# EasyEDA Pro project kuafu01_030内部老化方案_4.eprj, board PCB4 (continued)
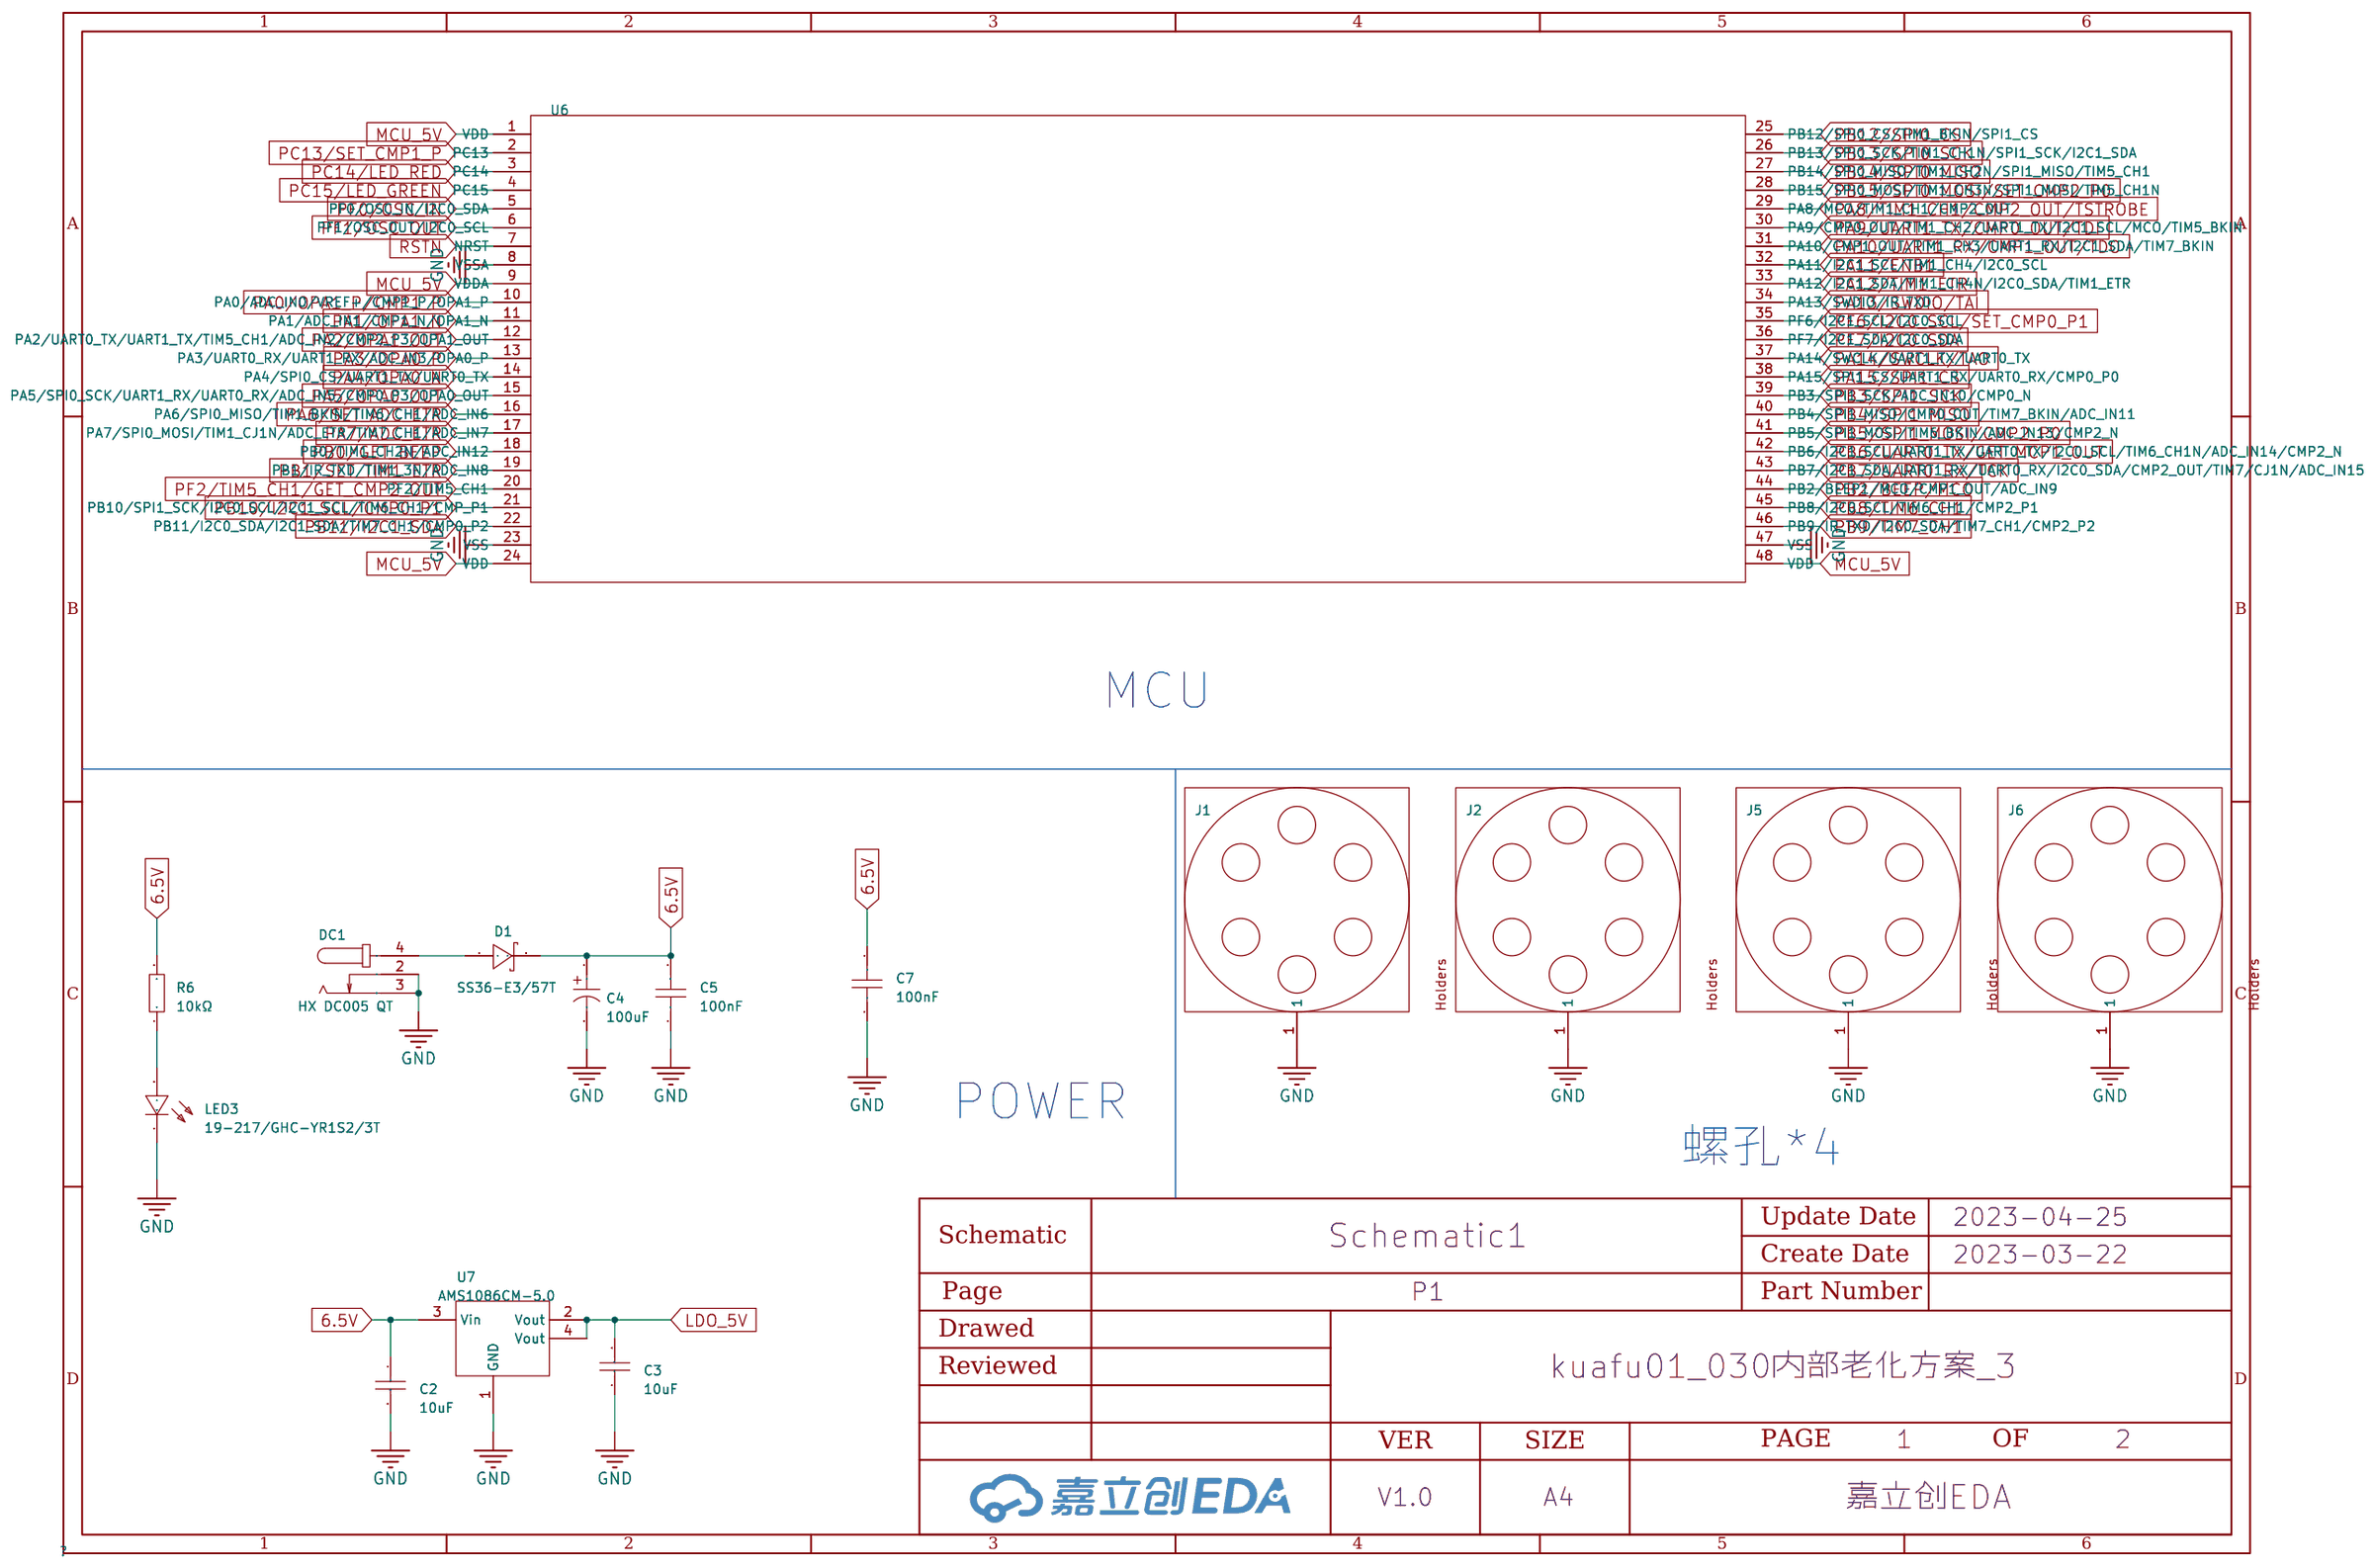
[diagram p0: P1]
## Routing (per net, layer and track width the routed paths; a pad name or vN(x,y) marks a point on that pad's centre or on a via; arc(x,y) is an arc through that point) (continued)
  Bottom Layer w0.5: v2(101.11,39.43) 103.02,41.34 v2(103.02,41.71) ; v2(101.11,114.62) 103.02,116.53 v2(103.02,116.9) ; v2(52.47,116.9) 52.47,116.53 v2(50.56,114.62) ; v2(103.02,192.08) 103.02,191.71 v2(101.11,189.8) ; v2(103.02,158.45) 103.02,164.68 v2(103.04,164.7) ; v2(204.13,127.11) 204.11,127.09 v2(204.11,120.86) ; v2(202.2,39.43) 204.11,41.34 v2(204.11,41.71) ; v2(103.02,154.49) 103.02,154.12 v2(101.11,152.21) ; v2(254.66,158.45) 254.66,164.68 v2(254.68,164.7) ; v2(153.57,83.27) 153.57,89.5 v2(153.59,89.52) ; v2(52.47,229.67) 52.47,229.3 v2(50.56,227.39) ; v2(52.47,79.31) 52.47,78.94 v2(50.56,77.03) ; v2(103.02,196.04) 103.02,202.27 v2(103.04,202.29) ; v2(52.47,120.86) 52.47,127.09 v2(52.49,127.11) ; v2(252.75,114.62) 254.66,116.53 v2(254.66,116.9) ; v2(153.59,51.92) 153.57,51.9 v2(153.57,45.67) ; v2(103.04,127.11) 103.02,127.09 v2(103.02,120.86) ; v2(52.47,196.04) 52.47,202.27 v2(52.49,202.29) ; v2(204.13,239.88) 204.11,239.86 v2(204.11,233.63) ; v2(153.59,164.7) 153.57,164.68 v2(153.57,158.45) ; v2(151.66,39.43) 153.57,41.34 v2(153.57,41.71) ; v2(204.11,79.31) 204.11,78.94 v2(202.2,77.03) ; v2(52.47,45.67) 52.47,51.9 v2(52.49,51.92) ; v2(50.56,189.8) 52.47,191.71 v2(52.47,192.08) ; v2(101.11,77.03) 103.02,78.94 v2(103.02,79.31) ; v2(103.02,83.27) 103.02,89.5 v2(103.04,89.52) ; v2(50.56,39.43) 52.47,41.34 v2(52.47,41.71) ; v2(254.66,8.08) 254.66,14.31 v2(254.68,14.33) ; v2(254.68,202.29) 254.66,202.27 v2(254.66,196.04) ; v2(254.66,41.71) 254.66,41.34 v2(252.75,39.43) ; v2(153.57,233.63) 153.57,239.86 v2(153.59,239.88) ; v2(204.13,51.92) 204.11,51.9 v2(204.11,45.67) ; v2(50.56,152.21) 52.47,154.12 v2(52.47,154.49) ; v2(204.11,154.49) 204.11,154.12 v2(202.2,152.21) ; v2(204.11,158.45) 204.11,164.68 v2(204.13,164.7) ; v2(204.11,83.27) 204.11,89.5 v2(204.13,89.52) ; v2(254.68,51.92) 254.66,51.9 v2(254.66,45.67) ; v2(151.66,227.39) 153.57,229.3 v2(153.57,229.67) ; v2(103.02,233.63) 103.02,239.86 v2(103.04,239.88) ; v2(50.56,1.84) 52.47,3.75 v2(52.47,4.12) ; v2(52.47,8.08) 52.47,14.31 v2(52.49,14.33) ; v2(52.49,89.52) 52.47,89.5 v2(52.47,83.27) ; v2(153.57,116.9) 153.57,116.53 v2(151.66,114.62) ; v2(103.02,45.67) 103.02,51.9 v2(103.04,51.92) ; v2(52.47,233.63) 52.47,239.86 v2(52.49,239.88) ; v2(103.02,229.67) 103.02,229.3 v2(101.11,227.39) ; v2(202.2,189.8) 204.11,191.71 v2(204.11,192.08) ; v2(151.66,189.8) 153.57,191.71 v2(153.57,192.08) ; v2(254.66,233.63) 254.66,239.86 v2(254.68,239.88) ; v2(252.75,227.39) 254.66,229.3 v2(254.66,229.67) ; v2(254.68,89.52) 254.66,89.5 v2(254.66,83.27) ; v2(252.75,189.8) 254.66,191.71 v2(254.66,192.08) ; v2(254.66,154.49) 254.66,154.12 v2(252.75,152.21) ; v2(153.57,120.86) 153.57,127.09 v2(153.59,127.11) ; v2(204.11,196.04) 204.11,202.27 v2(204.13,202.29) ; v2(153.57,196.04) 153.57,202.27 v2(153.59,202.29) ; v2(153.57,79.31) 153.57,78.94 v2(151.66,77.03) ; v2(254.68,127.11) 254.66,127.09 v2(254.66,120.86) ; v2(153.57,154.49) 153.57,154.12 v2(151.66,152.21) ; v2(202.2,227.39) 204.11,229.3 v2(204.11,229.67) ; v2(252.75,1.84) 254.66,3.75 v2(254.66,4.12) ; v2(254.66,79.31) 254.66,78.94 v2(252.75,77.03) ; v2(202.2,114.62) 204.11,116.53 v2(204.11,116.9) ; v2(52.49,164.7) 52.47,164.68 v2(52.47,158.45)
PF0/OSC_IN: length 168.7
  Top Layer w0.28: X1#20.1 173.56,88.24 U6#21.5 ; X1#26.1 173.56,238.61 U6#25.5 ; 26.63,13.06 21.92,13.06 X1#24.1 ; U6#32.5 173.56,201.02 X1#32.1 ; X1#31.1 123.01,201.02 127.73,201.02 ; X1#9.1 173.56,163.42 U6#10.5 ; X1#7.1 224.1,125.83 228.82,125.83 ; 228.82,50.65 224.1,50.65 X1#18.1 ; 228.82,238.61 224.1,238.61 X1#27.1 ; U6#29.5 72.46,201.02 X1#30.1 ; U6#5.5 72.46,125.83 X1#10.1 ; 26.63,238.61 21.92,238.61 X1#23.1 ; X1#12.1 123.01,50.65 127.73,50.65 ; 228.82,13.06 224.1,13.06 X1#25.1 ; X1.1 72.46,238.61 U6.5 ; 127.73,238.61 123.01,238.61 X1#16.1 ; U6#18.5 173.56,50.65 X1#14.1 ; X1#4.1 173.56,125.83 U6#7.5 ; X1#28.1 224.1,201.02 228.82,201.02 ; 127.73,163.42 123.01,163.42 X1#8.1 ; 127.73,125.83 123.01,125.83 X1#2.1 ; X1#17.1 21.92,88.24 26.63,88.24 ; 26.63,125.83 21.92,125.83 X1#3.1 ; X1#5.1 224.1,163.42 228.82,163.42 ; 26.63,163.42 21.92,163.42 X1#6.1 ; X1#13.1 21.92,50.65 26.63,50.65 ; 228.82,88.24 224.1,88.24 X1#15.1 ; X1#19.1 123.01,88.24 127.73,88.24 ; U6#16.5 72.46,50.65 X1#21.1 ; X1#29.1 21.92,201.02 26.63,201.02 ; X1#22.1 72.46,88.24 U6#22.5 ; U6#11.5 72.46,163.42 X1#11.1
PF1/OSC_OUT: length 317.6
  Top Layer w0.28: 120.34,237.13 122.1,235.37 123.41,235.37 124.7,236.66 124.7,237.83 124.98,238.11 127.73,238.11 ; 127.73,87.74 124.98,87.74 124.7,87.46 124.7,86.29 123.41,85.01 122.1,85.01 120.34,86.76 ; 127.73,125.33 124.98,125.33 124.7,125.05 124.7,123.88 123.41,122.6 122.1,122.6 120.34,124.36 ; 228.82,125.33 226.07,125.33 225.79,125.05 225.79,123.88 224.51,122.6 223.19,122.6 221.44,124.36 ; 228.82,12.56 226.07,12.56 225.79,12.28 225.79,11.11 224.51,9.82 223.19,9.82 221.44,11.58 ; 19.25,11.58 21.01,9.82 22.32,9.82 23.61,11.11 23.61,12.28 23.89,12.56 26.63,12.56 ; 170.89,86.76 172.65,85.01 173.96,85.01 175.24,86.29 175.24,87.46 175.52,87.74 U6#21.6 ; U6#5.6 74.43,125.33 74.15,125.05 74.15,123.88 72.87,122.6 71.56,122.6 69.8,124.36 ; U6#10.6 175.52,162.92 175.24,162.64 175.24,161.47 173.96,160.19 172.65,160.19 170.89,161.95 ; 69.8,199.54 71.56,197.78 72.87,197.78 74.15,199.07 74.15,200.24 74.43,200.52 U6#29.6 ; 170.89,237.13 172.65,235.37 173.96,235.37 175.24,236.66 175.24,237.83 175.52,238.11 U6#25.6 ; 221.44,199.54 223.19,197.78 224.51,197.78 225.79,199.07 225.79,200.24 226.07,200.52 228.82,200.52 ; U6#16.6 74.43,50.15 74.15,49.87 74.15,48.7 72.87,47.41 71.56,47.41 69.8,49.17 ; 170.89,124.36 172.65,122.6 173.96,122.6 175.24,123.88 175.24,125.05 175.52,125.33 U6#7.6 ; 120.34,49.17 122.1,47.41 123.41,47.41 124.7,48.7 124.7,49.87 124.98,50.15 127.73,50.15 ; 127.73,162.92 124.98,162.92 124.7,162.64 124.7,161.47 123.41,160.19 122.1,160.19 120.34,161.95 ; 127.73,200.52 124.98,200.52 124.7,200.24 124.7,199.07 123.41,197.78 122.1,197.78 120.34,199.54 ; 26.63,162.92 23.89,162.92 23.61,162.64 23.61,161.47 22.32,160.19 21.01,160.19 19.25,161.95 ; 221.44,49.17 223.19,47.41 224.51,47.41 225.79,48.7 225.79,49.87 226.07,50.15 228.82,50.15 ; 228.82,87.74 226.07,87.74 225.79,87.46 225.79,86.29 224.51,85.01 223.19,85.01 221.44,86.76 ; 19.25,86.76 21.01,85.01 22.32,85.01 23.61,86.29 23.61,87.46 23.89,87.74 26.63,87.74 ; 170.89,49.17 172.65,47.41 173.96,47.41 175.24,48.7 175.24,49.87 175.52,50.15 U6#18.6 ; U6#11.6 74.43,162.92 74.15,162.64 74.15,161.47 72.87,160.19 71.56,160.19 69.8,161.95 ; 221.44,161.95 223.19,160.19 224.51,160.19 225.79,161.47 225.79,162.64 226.07,162.92 228.82,162.92 ; 228.82,238.11 226.07,238.11 225.79,237.83 225.79,236.66 224.51,235.37 223.19,235.37 221.44,237.13 ; 19.25,199.54 21.01,197.78 22.32,197.78 23.61,199.07 23.61,200.24 23.89,200.52 26.63,200.52 ; 69.8,86.76 71.56,85.01 72.87,85.01 74.15,86.29 74.15,87.46 74.43,87.74 U6#22.6 ; 19.25,237.13 21.01,235.37 22.32,235.37 23.61,236.66 23.61,237.83 23.89,238.11 26.63,238.11 ; U6.6 74.43,238.11 74.15,237.83 74.15,236.66 72.87,235.37 71.56,235.37 69.8,237.13 ; 170.89,199.54 172.65,197.78 173.96,197.78 175.24,199.07 175.24,200.24 175.52,200.52 U6#32.6 ; 26.63,50.15 23.89,50.15 23.61,49.87 23.61,48.7 22.32,47.41 21.01,47.41 19.25,49.17 ; 19.25,124.36 21.01,122.6 22.32,122.6 23.61,123.88 23.61,125.05 23.89,125.33 26.63,125.33
PF2/TIM5_CH1/GET_CMP2_OUT: length 879
  Top Layer w0.28: v1(39.57,42.28) 32.13,42.28 31.58,42.84 U6#14.20 ; v1(241.76,79.88) 234.32,79.88 233.77,80.43 U6#17.20 ; 183.22,120.88 183.22,118.02 183.77,117.47 v1(191.21,117.47) ; U6#3.20 31.58,118.02 32.13,117.47 v1(39.57,117.47) ; U6#2.20 132.68,118.02 133.23,117.47 v1(140.67,117.47) ; v1(90.12,117.47) 82.68,117.47 82.13,118.02 82.13,120.88 ; U6#31.20 31.58,193.2 32.13,192.65 v1(39.57,192.65) ; v1(241.76,42.28) 234.32,42.28 233.77,42.84 U6#15.20 ; U6#23.20 31.58,5.24 32.13,4.69 v1(39.57,4.69) ; U6#4.20 233.77,118.02 234.32,117.47 v1(241.76,117.47) ; U6#8.20 132.68,155.61 133.23,155.06 v1(140.67,155.06) ; v1(140.67,192.65) 133.23,192.65 132.68,193.2 U6#30.20 ; v1(140.67,79.88) 133.23,79.88 132.68,80.43 U6#19.20 ; v1(90.12,192.65) 82.68,192.65 82.13,193.2 82.13,196.07 ; v1(191.21,42.28) 183.77,42.28 183.22,42.84 183.22,45.7 ; U6#9.20 31.58,155.61 32.13,155.06 v1(39.57,155.06) ; v1(90.12,79.88) 82.68,79.88 82.13,80.43 82.13,83.29 ; U6#12.20 132.68,230.8 133.23,230.24 v1(140.67,230.24) ; U6#24.20 233.77,5.24 234.32,4.69 v1(241.76,4.69) ; U6#20.20 31.58,80.43 32.13,79.88 v1(39.57,79.88) ; 183.22,83.29 183.22,80.43 183.77,79.88 v1(191.21,79.88) ; v1(191.21,155.06) 183.77,155.06 183.22,155.61 183.22,158.47 ; v1(191.21,192.65) 183.77,192.65 183.22,193.2 183.22,196.07 ; U6#6.20 233.77,155.61 234.32,155.06 v1(241.76,155.06) ; v1(90.12,230.24) 82.68,230.24 82.13,230.8 82.13,233.66 ; v1(90.12,42.28) 82.68,42.28 82.13,42.84 82.13,45.7 ; U6#13.20 132.68,42.84 133.23,42.28 v1(140.67,42.28) ; v1(39.57,230.24) 32.13,230.24 31.58,230.8 U6#27.20 ; 183.22,233.66 183.22,230.8 183.77,230.24 v1(191.21,230.24) ; v1(90.12,155.06) 82.68,155.06 82.13,155.61 82.13,158.47 ; v1(241.76,230.24) 234.32,230.24 233.77,230.8 U6#26.20 ; U6#28.20 233.77,193.2 234.32,192.65 v1(241.76,192.65)
  Bottom Layer w0.28: v1(39.57,117.47) 41.22,115.82 48.2,115.82 49.04,116.66 49.04,119.94 48.33,120.65 H5#5.2 ; H5#30.2 98.88,195.83 99.59,195.12 99.59,191.84 98.75,191 91.77,191 v1(90.12,192.65) ; v1(140.67,230.24) 142.32,228.59 149.3,228.59 150.14,229.43 150.14,232.72 149.43,233.43 H5#11.2 ; v1(90.12,117.47) 91.77,115.82 98.75,115.82 99.59,116.66 99.59,119.94 98.88,120.65 H5#3.2 ; v1(39.57,79.88) 41.22,78.23 48.2,78.23 49.04,79.07 49.04,82.35 48.33,83.06 H5#15.2 ; H5#29.2 48.33,195.83 49.04,195.12 49.04,191.84 48.2,191 41.22,191 v1(39.57,192.65) ; v1(140.67,155.06) 142.32,153.41 149.3,153.41 150.14,154.25 150.14,157.53 149.43,158.24 H5#10.2 ; H5#31.2 149.43,195.83 150.14,195.12 150.14,191.84 149.3,191 142.32,191 v1(140.67,192.65) ; H5#23.2 48.33,7.87 49.04,7.16 49.04,3.88 48.2,3.04 41.22,3.04 v1(39.57,4.69) ; H5#17.2 250.52,45.47 251.23,44.76 251.23,41.47 250.39,40.63 243.41,40.63 v1(241.76,42.28) ; H5#2.2 149.43,120.65 150.14,119.94 150.14,116.66 149.3,115.82 142.32,115.82 v1(140.67,117.47) ; H5#6.2 250.52,120.65 251.23,119.94 251.23,116.66 250.39,115.82 243.41,115.82 v1(241.76,117.47) ; v1(191.21,42.28) 192.86,40.63 199.84,40.63 200.68,41.47 200.68,44.76 199.97,45.47 H5#18.2 ; v1(90.12,230.24) 91.77,228.59 98.75,228.59 99.59,229.43 99.59,232.72 98.88,233.43 H5.2 ; H5#13.2 149.43,45.47 150.14,44.76 150.14,41.47 149.3,40.63 142.32,40.63 v1(140.67,42.28) ; H5#9.2 98.88,158.24 99.59,157.53 99.59,154.25 98.75,153.41 91.77,153.41 v1(90.12,155.06) ; H5#32.2 199.97,195.83 200.68,195.12 200.68,191.84 199.84,191 192.86,191 v1(191.21,192.65) ; v1(241.76,79.88) 243.41,78.23 250.39,78.23 251.23,79.07 251.23,82.35 250.52,83.06 H5#19.2 ; H5#14.2 98.88,45.47 99.59,44.76 99.59,41.47 98.75,40.63 91.77,40.63 v1(90.12,42.28) ; v1(241.76,230.24) 243.41,228.59 250.39,228.59 251.23,229.43 251.23,232.72 250.52,233.43 H5#27.2 ; H5#7.2 199.97,120.65 200.68,119.94 200.68,116.66 199.84,115.82 192.86,115.82 v1(191.21,117.47) ; v1(191.21,155.06) 192.86,153.41 199.84,153.41 200.68,154.25 200.68,157.53 199.97,158.24 H5#12.2 ; H5#4.2 48.33,158.24 49.04,157.53 49.04,154.25 48.2,153.41 41.22,153.41 v1(39.57,155.06) ; v1(90.12,79.88) 91.77,78.23 98.75,78.23 99.59,79.07 99.59,82.35 98.88,83.06 H5#20.2 ; v1(241.76,155.06) 243.41,153.41 250.39,153.41 251.23,154.25 251.23,157.53 250.52,158.24 H5#8.2 ; v1(191.21,79.88) 192.86,78.23 199.84,78.23 200.68,79.07 200.68,82.35 199.97,83.06 H5#22.2 ; H5#25.2 199.97,233.43 200.68,232.72 200.68,229.43 199.84,228.59 192.86,228.59 v1(191.21,230.24) ; H5#24.2 250.52,7.87 251.23,7.16 251.23,3.88 250.39,3.04 243.41,3.04 v1(241.76,4.69) ; v1(39.57,42.28) 41.22,40.63 48.2,40.63 49.04,41.47 49.04,44.76 48.33,45.47 H5#16.2 ; H5#21.2 149.43,83.06 150.14,82.35 150.14,79.07 149.3,78.23 142.32,78.23 v1(140.67,79.88) ; H5#28.2 250.52,195.83 251.23,195.12 251.23,191.84 250.39,191 243.41,191 v1(241.76,192.65) ; v1(39.57,230.24) 41.22,228.59 48.2,228.59 49.04,229.43 49.04,232.72 48.33,233.43 H5#26.2
RSTN: length 574.7
  Top Layer w0.28: v1(24.25,124.68) 24.65,124.68 24.8,124.83 26.63,124.83 ; v1(74.8,162.27) 75.2,162.27 75.35,162.42 U6#11.7 ; v1(24.25,87.09) 24.65,87.09 24.8,87.24 26.63,87.24 ; v1(226.44,87.09) 226.83,87.09 226.99,87.24 228.82,87.24 ; v1(24.25,162.27) 24.65,162.27 24.8,162.42 26.63,162.42 ; v1(125.35,124.68) 125.74,124.68 125.9,124.83 127.73,124.83 ; U6#21.7 176.44,87.24 176.29,87.09 v1(175.89,87.09) ; U6#10.7 176.44,162.42 176.29,162.27 v1(175.89,162.27) ; 228.82,162.42 226.99,162.42 226.83,162.27 v1(226.44,162.27) ; 127.73,87.24 125.9,87.24 125.74,87.09 v1(125.35,87.09) ; 26.63,237.61 24.8,237.61 24.65,237.45 v1(24.25,237.45) ; v1(226.44,11.9) 226.83,11.9 226.99,12.06 228.82,12.06 ; v1(226.44,124.68) 226.83,124.68 226.99,124.83 228.82,124.83 ; v1(74.8,87.09) 75.2,87.09 75.35,87.24 U6#22.7 ; 127.73,200.02 125.9,200.02 125.74,199.86 v1(125.35,199.86) ; v1(24.25,11.9) 24.65,11.9 24.8,12.06 26.63,12.06 ; 127.73,162.42 125.9,162.42 125.74,162.27 v1(125.35,162.27) ; U6.7 75.35,237.61 75.2,237.45 v1(74.8,237.45) ; U6#7.7 176.44,124.83 176.29,124.68 v1(175.89,124.68) ; v1(74.8,49.49) 75.2,49.49 75.35,49.65 U6#16.7 ; 26.63,200.02 24.8,200.02 24.65,199.86 v1(24.25,199.86) ; U6#32.7 176.44,200.02 176.29,199.86 v1(175.89,199.86) ; 127.73,237.61 125.9,237.61 125.74,237.45 v1(125.35,237.45) ; v1(175.89,49.49) 176.29,49.49 176.44,49.65 U6#18.7 ; U6#25.7 176.44,237.61 176.29,237.45 v1(175.89,237.45) ; 228.82,237.61 226.99,237.61 226.83,237.45 v1(226.44,237.45) ; v1(226.44,49.49) 226.83,49.49 226.99,49.65 228.82,49.65 ; 228.82,200.02 226.99,200.02 226.83,199.86 v1(226.44,199.86) ; U6#5.7 75.35,124.83 75.2,124.68 v1(74.8,124.68) ; v1(125.35,49.49) 125.74,49.49 125.9,49.65 127.73,49.65 ; v1(24.25,49.49) 24.65,49.49 24.8,49.65 26.63,49.65 ; U6#29.7 75.35,200.02 75.2,199.86 v1(74.8,199.86)
  Bottom Layer w0.28: v1(125.35,87.09) 125.15,87.29 125.15,100.26 126.74,101.86 CN1#18.2 ; v1(74.8,49.49) 74.6,49.69 74.6,62.67 76.2,64.26 CN1#16.2 ; CN1#29.2 227.84,214.63 226.24,213.03 226.24,200.06 v1(226.44,199.86) ; CN1#26.2 227.84,252.22 226.24,250.63 226.24,237.65 v1(226.44,237.45) ; CN1#28.2 177.29,214.63 175.69,213.03 175.69,200.06 v1(175.89,199.86) ; v1(226.44,87.09) 226.24,87.29 226.24,100.26 227.84,101.86 CN1#17.2 ; v1(24.25,237.45) 24.05,237.65 24.05,250.63 25.65,252.22 CN1#24.2 ; CN1#11.2 126.74,252.22 125.15,250.63 125.15,237.65 v1(125.35,237.45) ; CN1#5.2 76.2,139.45 74.6,137.85 74.6,124.88 v1(74.8,124.68) ; v1(125.35,49.49) 125.15,49.69 125.15,62.67 126.74,64.26 CN1#19.2 ; v1(226.44,49.49) 226.24,49.69 226.24,62.67 227.84,64.26 CN1#12.2 ; CN1#20.2 76.2,101.86 74.6,100.26 74.6,87.29 v1(74.8,87.09) ; CN1#14.2 25.65,101.86 24.05,100.26 24.05,87.29 v1(24.25,87.09) ; CN1#30.2 76.2,214.63 74.6,213.03 74.6,200.06 v1(74.8,199.86) ; CN1#15.2 25.65,64.26 24.05,62.67 24.05,49.69 v1(24.25,49.49) ; v1(175.89,124.68) 175.69,124.88 175.69,137.85 177.29,139.45 CN1#10.2 ; v1(175.89,49.49) 175.69,49.69 175.69,62.67 177.29,64.26 CN1#21.2 ; CN1#9.2 76.2,177.04 74.6,175.44 74.6,162.47 v1(74.8,162.27) ; v1(24.25,199.86) 24.05,200.06 24.05,213.03 25.65,214.63 CN1#27.2 ; v1(226.44,124.68) 226.24,124.88 226.24,137.85 227.84,139.45 CN1.2 ; CN1#13.2 177.29,101.86 175.69,100.26 175.69,87.29 v1(175.89,87.09) ; v1(24.25,162.27) 24.05,162.47 24.05,175.44 25.65,177.04 CN1#3.2 ; v1(175.89,162.27) 175.69,162.47 175.69,175.44 177.29,177.04 CN1#2.2 ; CN1#31.2 126.74,214.63 125.15,213.03 125.15,200.06 v1(125.35,199.86) ; v1(175.89,237.45) 175.69,237.65 175.69,250.63 177.29,252.22 CN1#25.2 ; CN1#23.2 227.84,26.67 226.24,25.07 226.24,12.1 v1(226.44,11.9) ; v1(24.25,124.68) 24.05,124.88 24.05,137.85 25.65,139.45 CN1#4.2 ; v1(226.44,162.27) 226.24,162.47 226.24,175.44 227.84,177.04 CN1#6.2 ; CN1#7.2 126.74,177.04 125.15,175.44 125.15,162.47 v1(125.35,162.27) ; CN1#32.2 76.2,252.22 74.6,250.63 74.6,237.65 v1(74.8,237.45) ; v1(24.25,11.9) 24.05,12.1 24.05,25.07 25.65,26.67 CN1#22.2 ; CN1#8.2 126.74,139.45 125.15,137.85 125.15,124.88 v1(125.35,124.68)
